# EasyEDA Pro project ProPrj_Avaota A1 八核 AIoT 开发板_2024-05-20.epro, schematic Avaota Pi A, sheets 6 to 13 of 13

## Sheets
6 PERF1
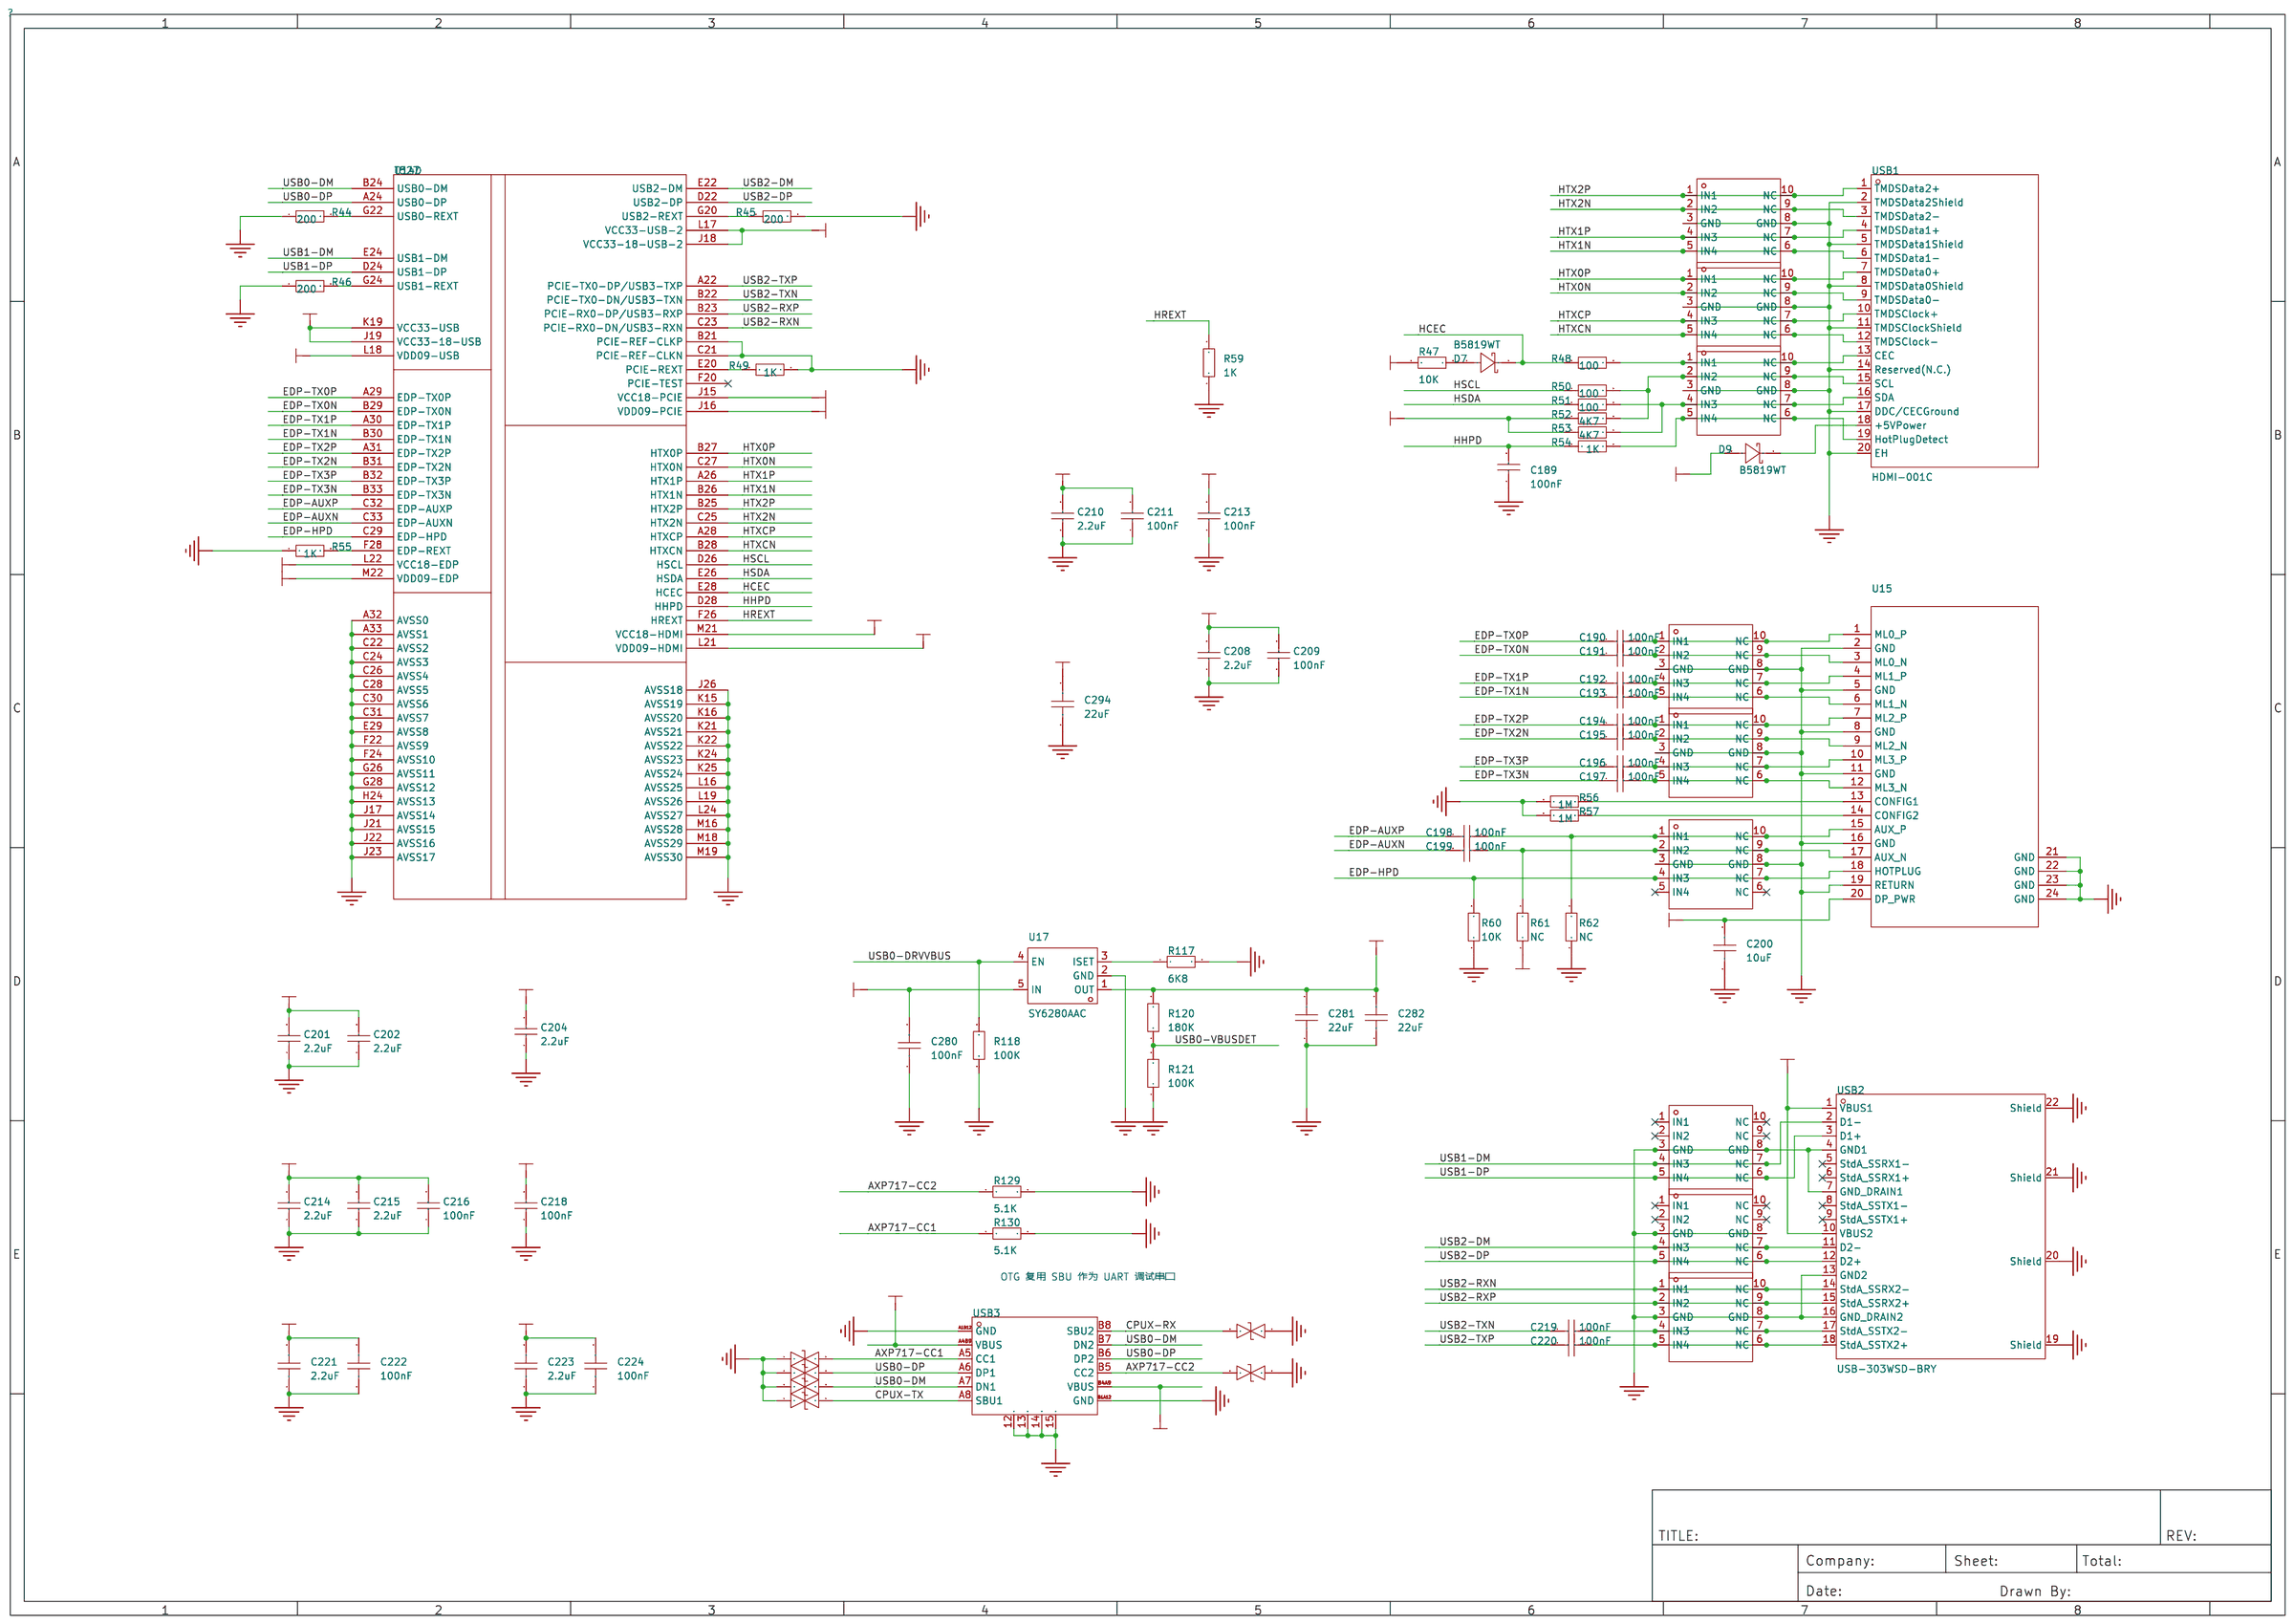
[diagram p7: PERF1]
7 BLOCK
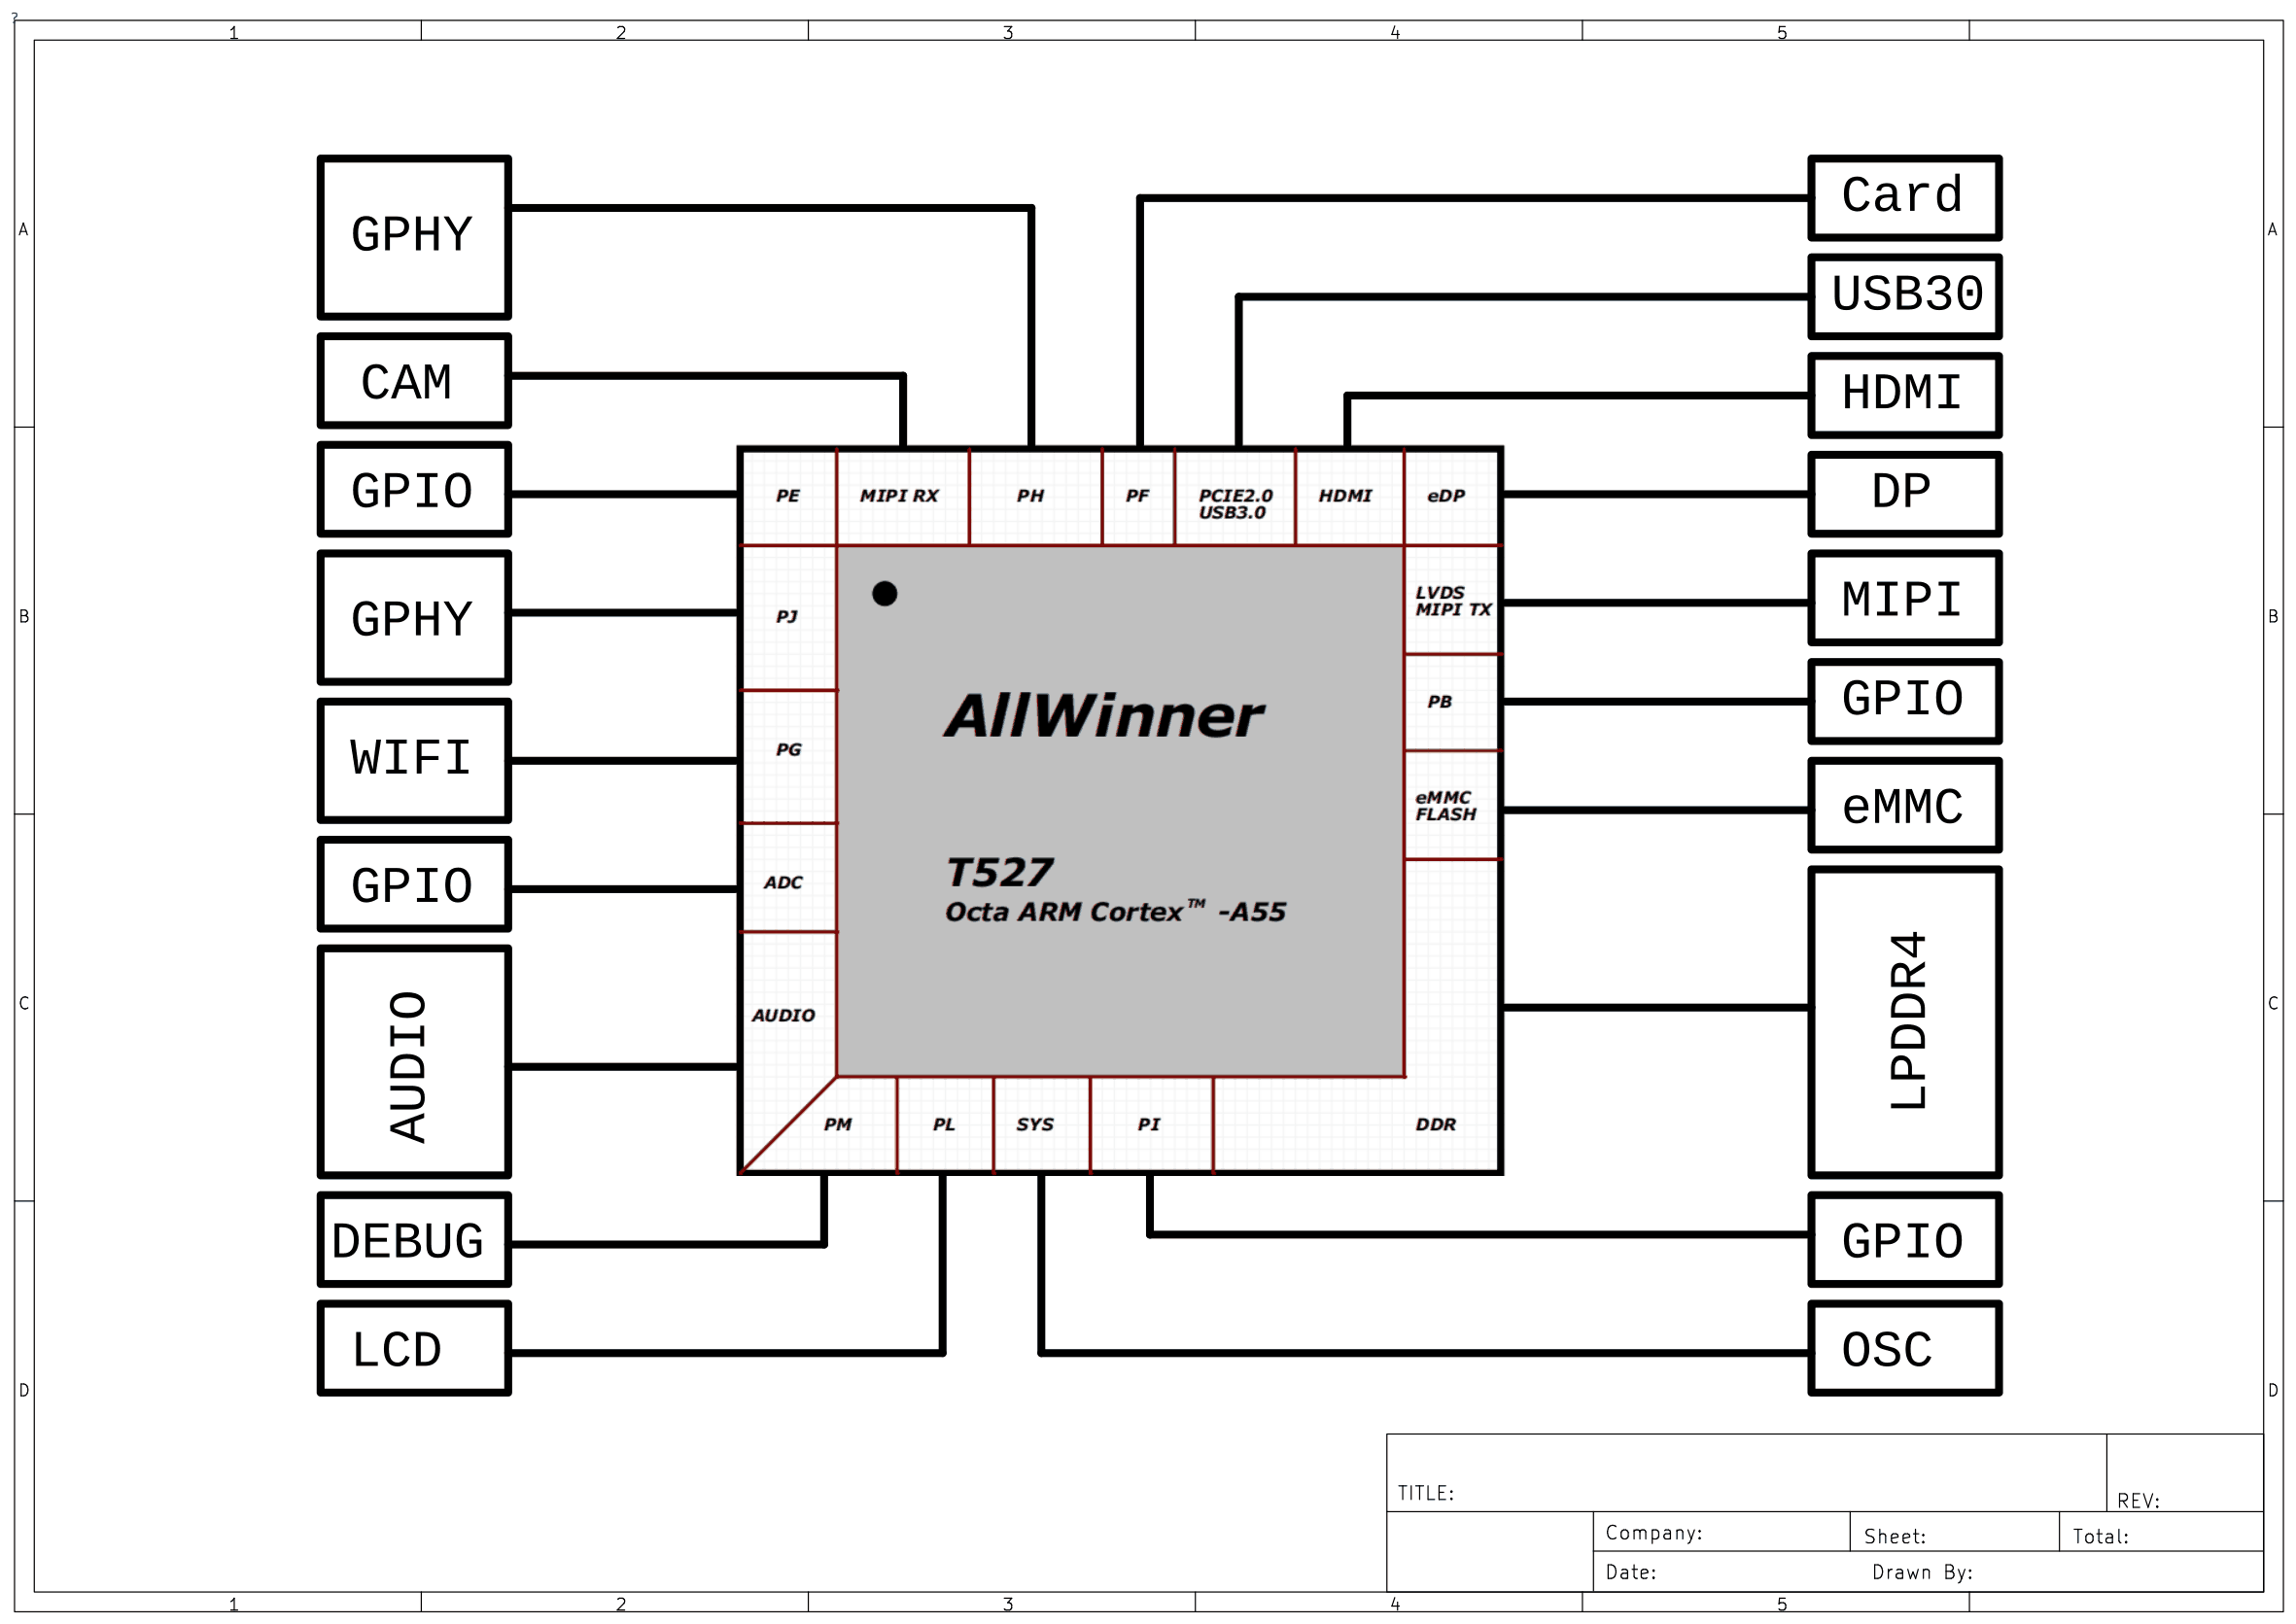
[diagram p8: BLOCK]
8 PERF2
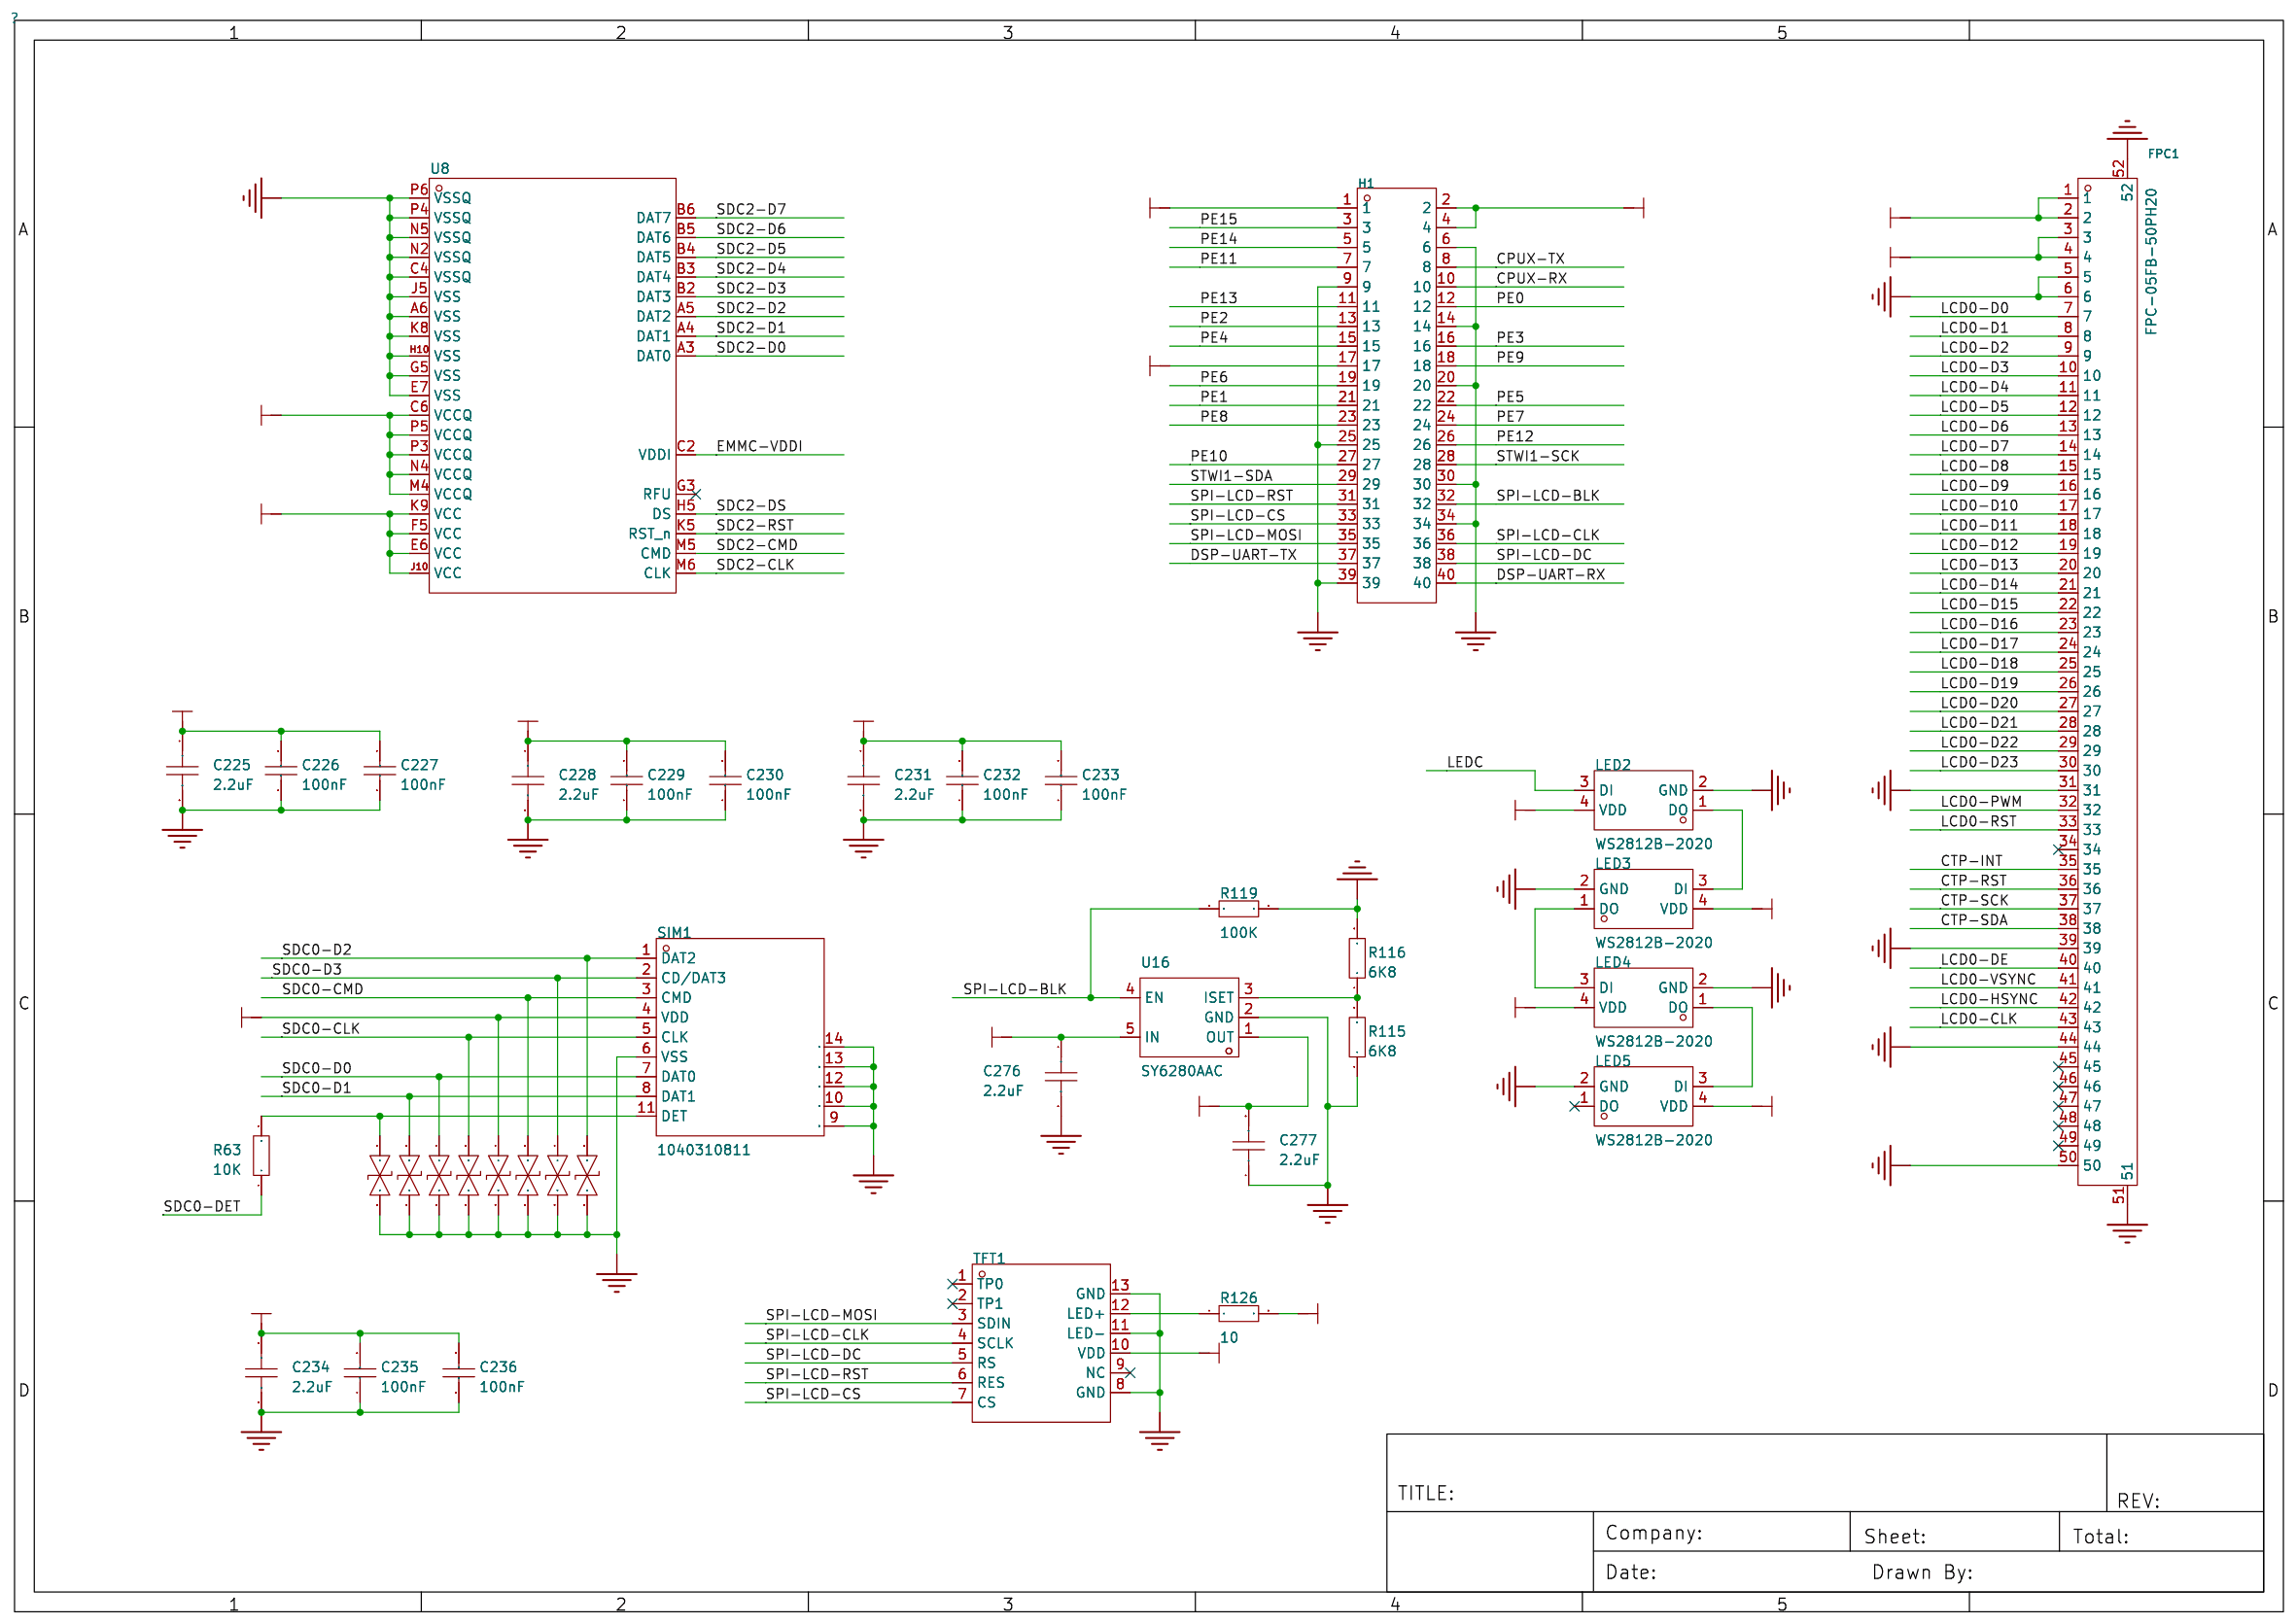
[diagram p9: PERF2]
9 GMAC0
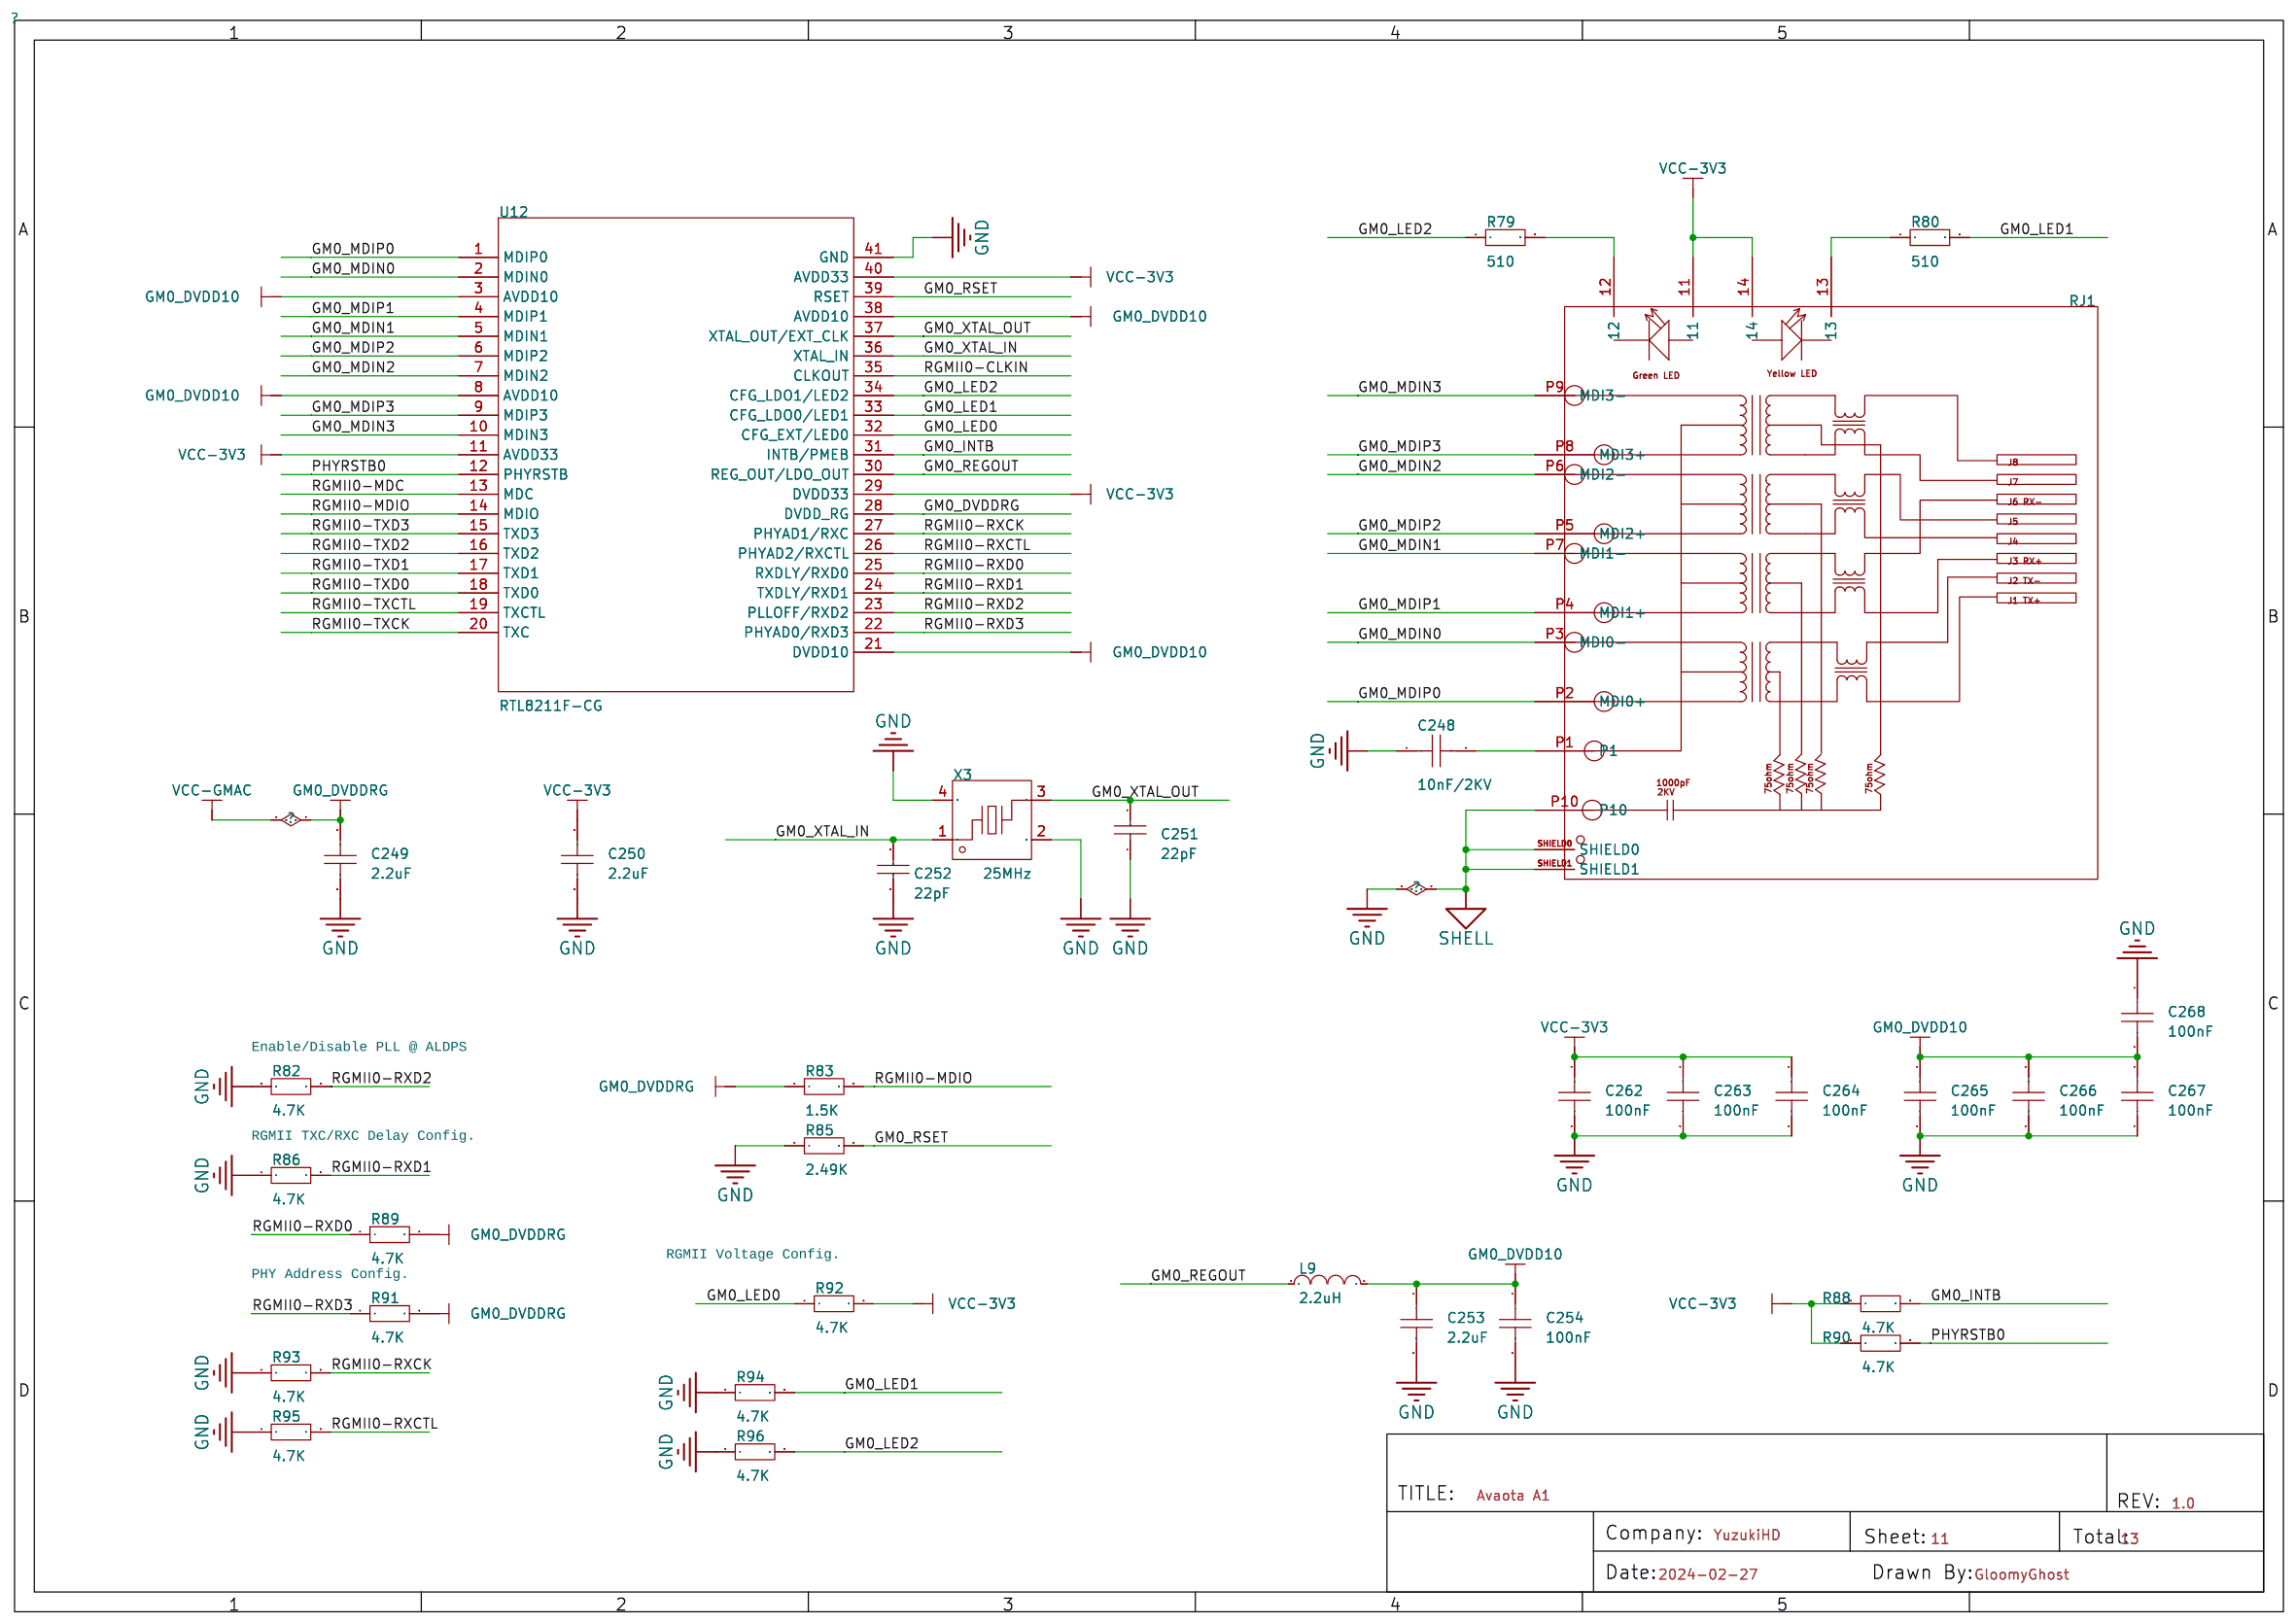
[diagram p10: GMAC0]
10 GMAC1